# Altium schematic sheet klpfly.SchDoc: klpfly
size 599 x 400 mm; Organization: 国产飞控; Address1: AT32F435VMT7; Address2: 北京; Address3: 房山; Address4: 测试版本; DocumentNumber: 1; Revision: v1.0; SheetNumber: 1; SheetTotal: 1
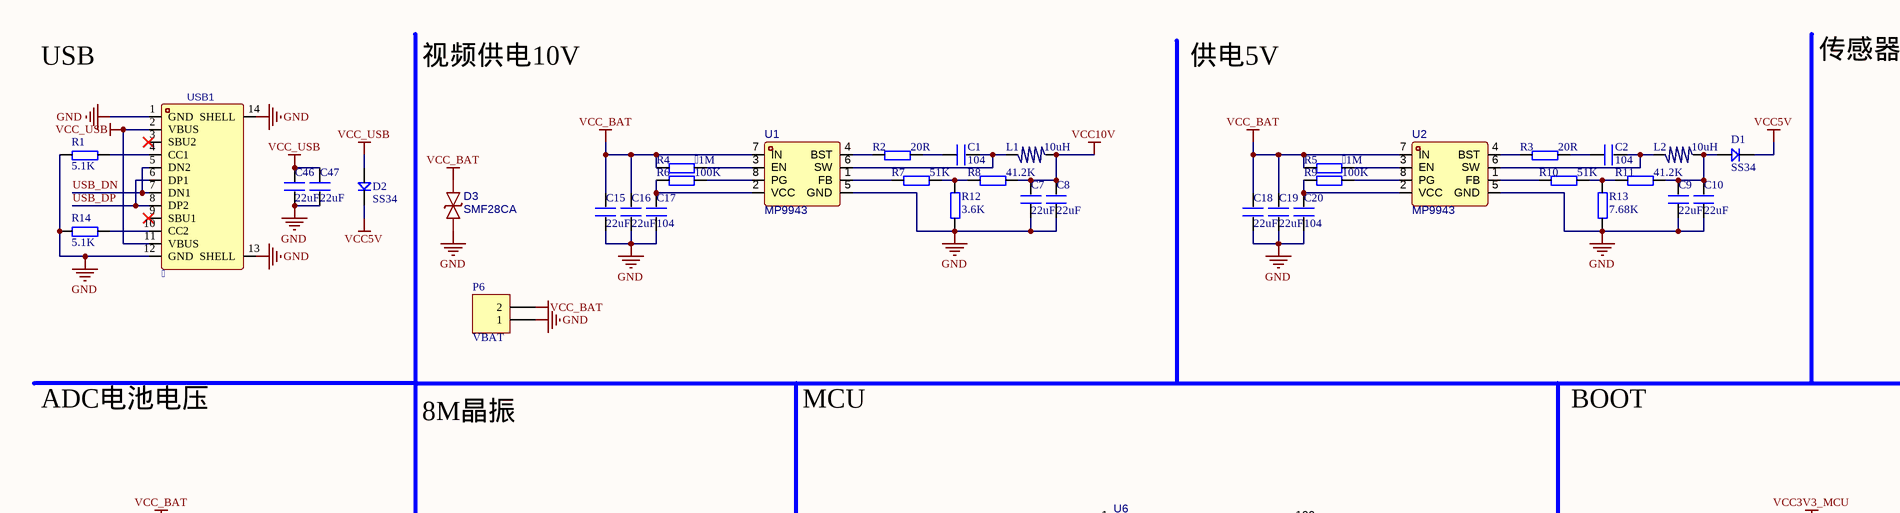
[diagram p0: klpfly.SchDoc, top left]
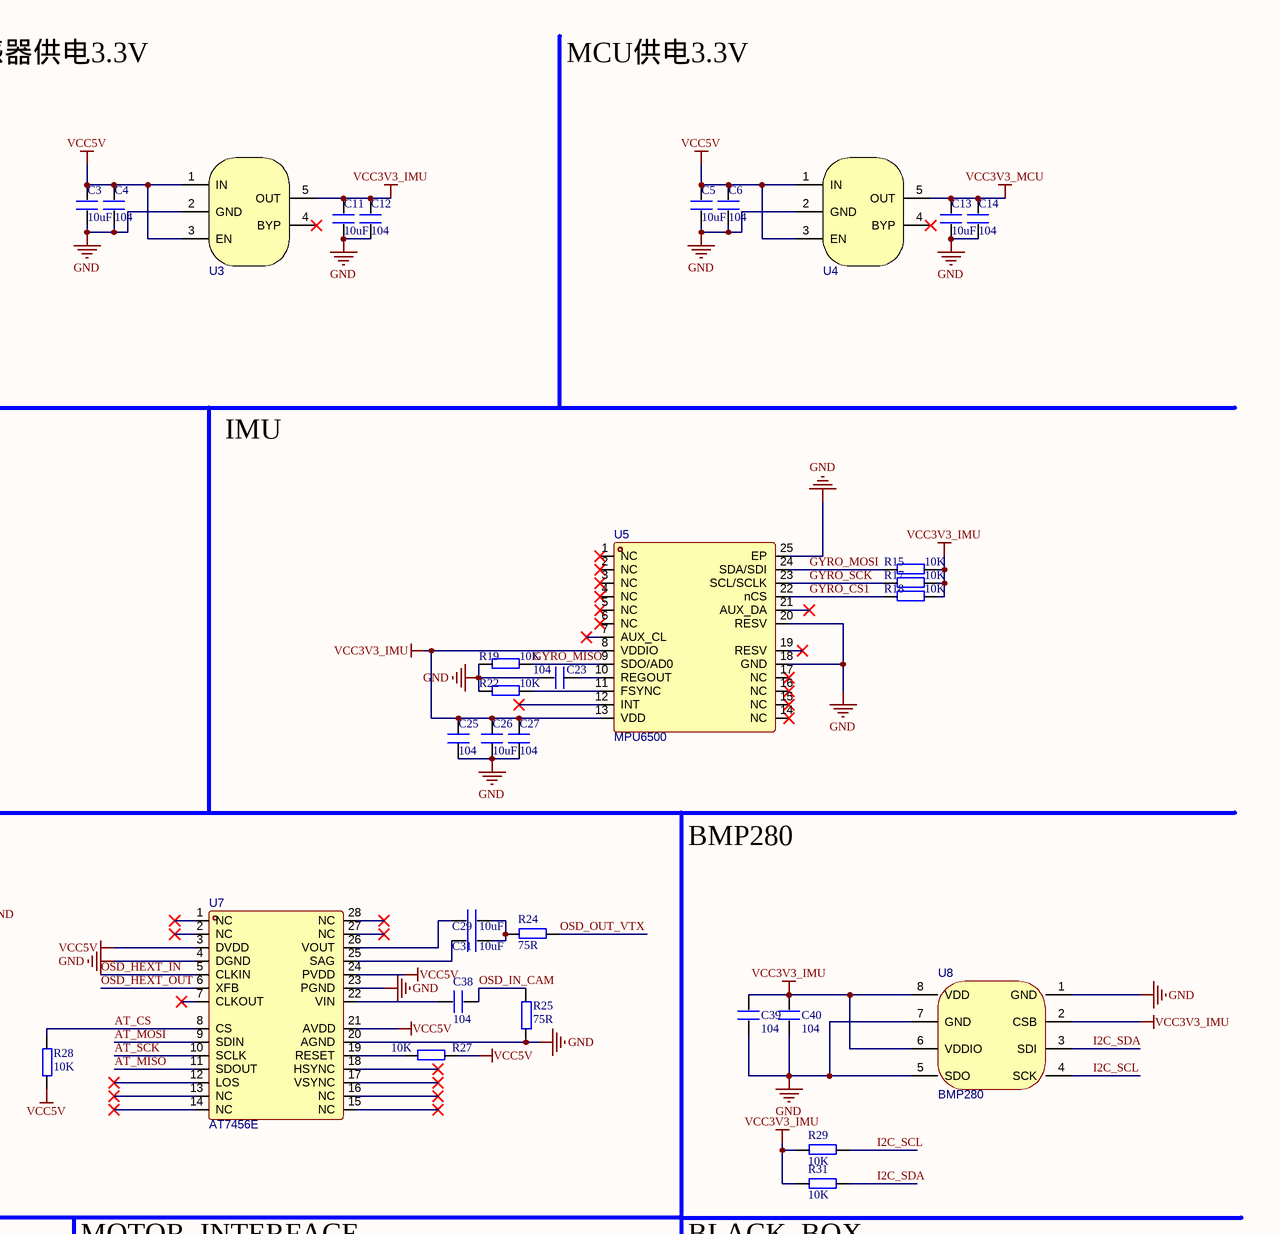
[diagram p1: klpfly.SchDoc, top right]
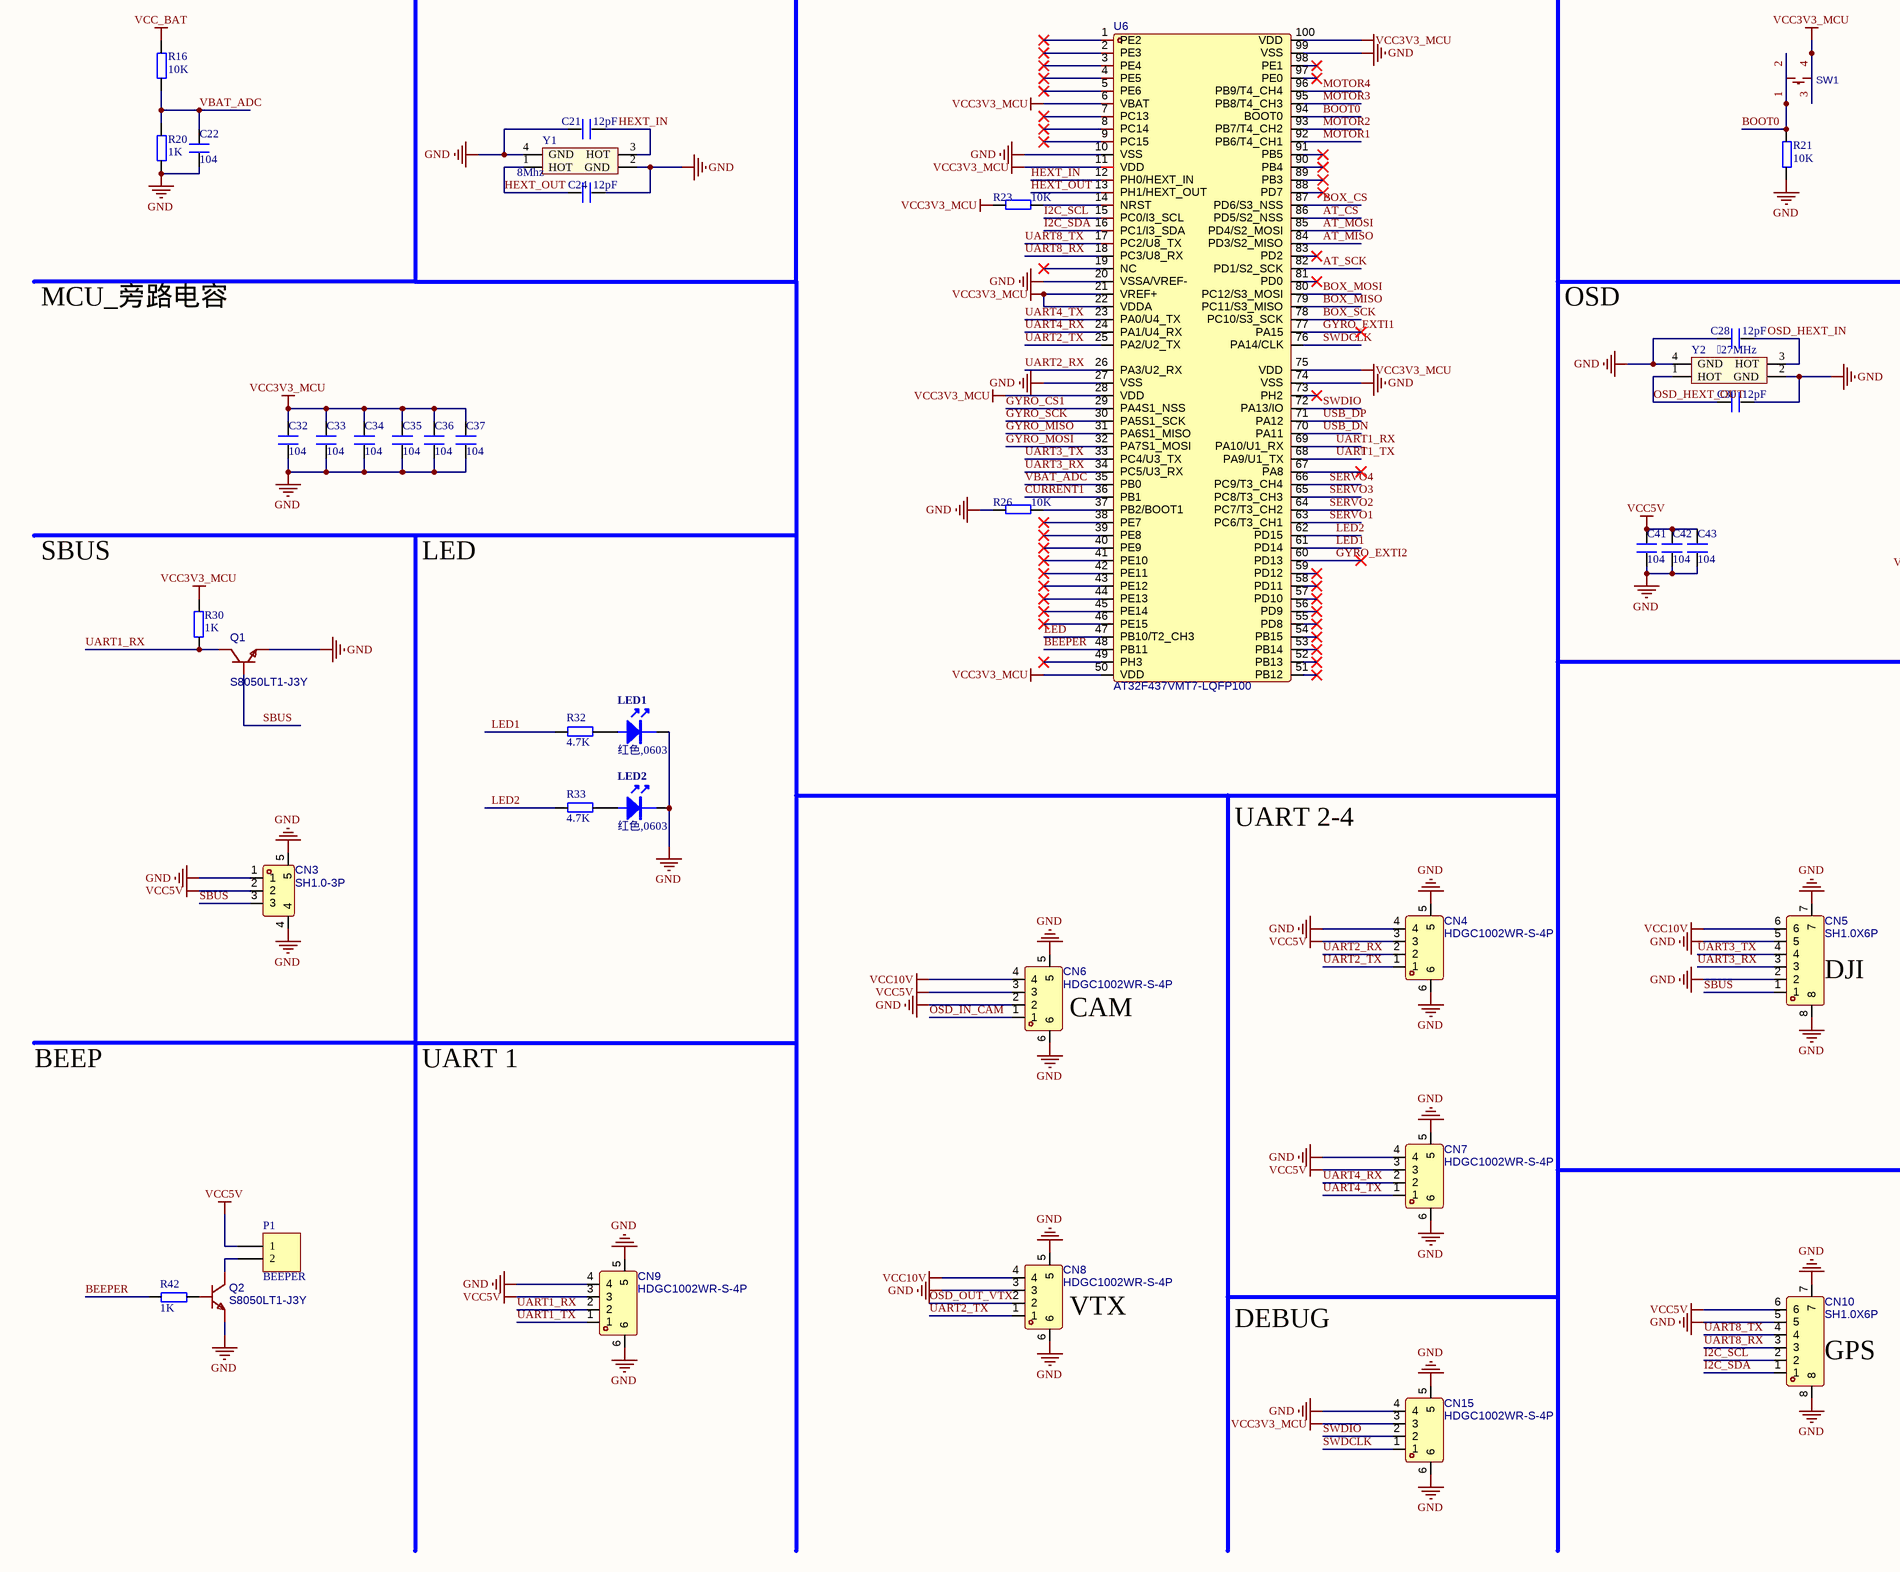
[diagram p2: klpfly.SchDoc, bottom left]
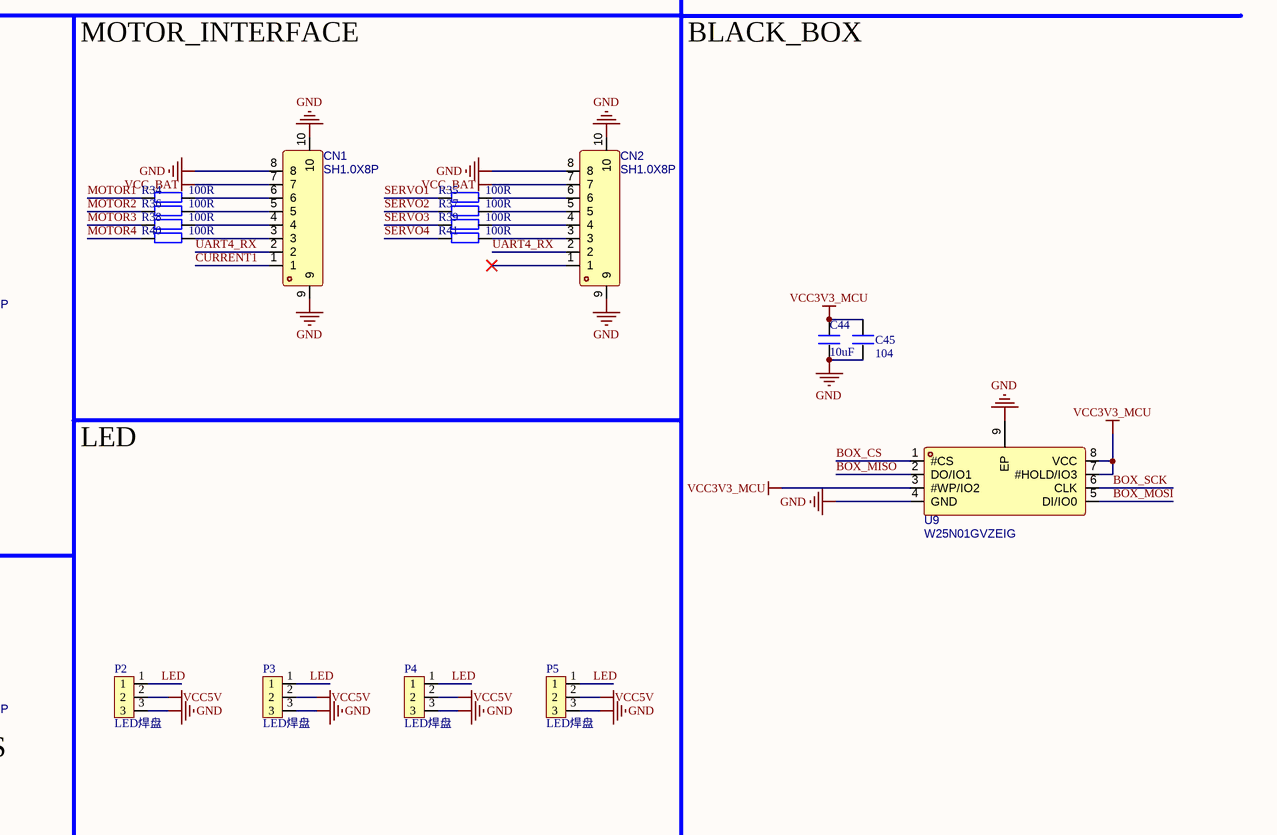
[diagram p3: klpfly.SchDoc, bottom right]

## Parts
C1  104  [0402C]
C2  104  [0402C]
C3  10uF  [0603C]
C4  104  [0402C]
C5  10uF  [0603C]
C6  104  [0402C]
C7  22uF  [0805C]
C8  22uF  [0805C]
C9  22uF  [0805C]
C10  22uF  [0805C]
C11  10uF  [0603C]
C12  104  [0402C]
C13  10uF  [0603C]
C14  104  [0402C]
C15  22uF  [0805C]
C16  22uF  [0805C]
C17  104  [0402C]
C18  22uF  [0805C]
C19  22uF  [0805C]
C20  104  [0402C]
C21  12pF  [0402C]
C22  104  [0402C]
C23  104  [0402C]
C24  12pF  [0402C]
C25  104  [0402C]
C26  10uF  [0603C]
C27  104  [0402C]
C28  12pF  [0402C]
C29  10uF  [0603C]
C30  12pF  [0402C]
C31  10uF  [0603C]
C32  104  [0402C]
C33  104  [0402C]
C34  104  [0402C]
C35  104  [0402C]
C36  104  [0402C]
C37  104  [0402C]
C38  104  [0402C]
C39  104  [0402C]
C40  104  [0402C]
C41  104  [0402C]
C42  104  [0402C]
C43  104  [0402C]
C44  10uF  [0603C]
C45  104  [0402C]
C46  22uF  [0805C]
C47  22uF  [0805C]
CN1  SH1.0X8P  [CONN-SMD_8P-P1.00_WAFER-SH1.0-8PWB]
CN2  SH1.0X8P  [CONN-SMD_8P-P1.00_WAFER-SH1.0-8PWB]
CN3  SH1.0-3P  [CONN-SMD_3P-P1.00_HDGC_HDGC1002WR-S-3P]
CN4  HDGC1002WR-S-4P  [CONN-SMD_4P-P1.00_HDGC_HDGC1002WR-S-4P]
CN5  SH1.0X6P  [CONN-SMD_6P-P1.00_MEGASTAR_ZX-SH1.0-6PWT]
CN6  HDGC1002WR-S-4P  [CONN-SMD_4P-P1.00_HDGC_HDGC1002WR-S-4P]
CN7  HDGC1002WR-S-4P  [CONN-SMD_4P-P1.00_HDGC_HDGC1002WR-S-4P]
CN8  HDGC1002WR-S-4P  [CONN-SMD_4P-P1.00_HDGC_HDGC1002WR-S-4P]
CN9  HDGC1002WR-S-4P  [CONN-SMD_4P-P1.00_HDGC_HDGC1002WR-S-4P]
CN10  SH1.0X6P  [CONN-SMD_6P-P1.00_MEGASTAR_ZX-SH1.0-6PWT]
CN15  HDGC1002WR-S-4P  [CONN-SMD_4P-P1.00_HDGC_HDGC1002WR-S-4P]
D1  SS34  [SOD-123]
D2  SS34  [SOD-123]
D3  SMF28CA  [SOD-123_L2.7-W1.8-LS3.7-BI]
L1  10uH  [IND-SMD_L4.3-W4.0_GPSR0420]
L2  10uH  [IND-SMD_L4.3-W4.0_GPSR0420]
LED1  value 红色,0603  [LED-0603]  (hidden comment: LED1)
LED2  value 红色,0603  [LED-0603]  (hidden comment: LED1)
P1  BEEPER  [2P]
P2  LED焊盘  [3P]
P3  LED焊盘  [3P]
P4  LED焊盘  [3P]
P5  LED焊盘  [3P]
P6  VBAT  [2P]
Q1  S8050LT1-J3Y  [SOT-23_L2.9-W1.3-P1.90-LS2.4-BR]
Q2  S8050LT1-J3Y  [SOT-23_L2.9-W1.3-P1.90-LS2.4-BR]
R1  5.1K  [0402R]
R2  20R  [0402R]
R3  20R  [0402R]
R4  1M  [0402R]
R5  1M  [0402R]
R6  100K  [0402R]
R7  51K  [0402R]
R8  41.2K  [0402R]
R9  100K  [0402R]
R10  51K  [0402R]
R11  41.2K  [0402R]
R12  3.6K  [0402R]
R13  7.68K  [0402R]
R14  5.1K  [0402R]
R15  10K  [0402R]
R16  10K  [0402R]
R17  10K  [0402R]
R18  10K  [0402R]
R19  10K  [0402R]
R20  1K  [0402R]
R21  10K  [0402R]
R22  10K  [0402R]
R23  10K  [0402R]
R24  75R  [0402R]
R25  75R  [0402R]
R26  10K  [0402R]
R27  10K  [0402R]
R28  10K  [0402R]
R29  10K  [0402R]
R30  1K  [0402R]
R31  10K  [0402R]
R32  4.7K  [0402R]
R33  4.7K  [0402R]
R34  100R  [0402R]
R35  100R  [0402R]
R36  100R  [0402R]
R37  100R  [0402R]
R38  100R  [0402R]
R39  100R  [0402R]
R40  100R  [0402R]
R41  100R  [0402R]
R42  1K  [0402R]
SW1  TS3425BA  [SW-SMD_4P-L4.2-W3.2-P2.15-LS4.6-1]  (value not drawn)
U1  MP9943  [QFN-8-3X3]
U2  MP9943  [QFN-8-3X3]
U3  SPX3819M5-L-3-3/TR  [SOT-23-5_L3.0-W1.7-P0.95-LS2.8-BL]  (value not drawn)
U4  SPX3819M5-L-3-3/TR  [SOT-23-5_L3.0-W1.7-P0.95-LS2.8-BL]  (value not drawn)
U5  MPU6500  [QFN-24_L3.0-W3.0-P0.40-BL-EP]
U6  AT32F437VMT7-LQFP100  [LQFP-100_L14.0-W14.0-P0.50-LS16.0-TL]
U7  AT7456E  [TSSOP-28_L9.7-W4.4-P0.65-LS6.4-BL-EP5.5]
U8  BMP280  [SENSOR-TH_BMP280-BL]
U9  W25N01GVZEIG  [WSON-8_L8.0-W6.10-P1.27-EP]
USB1    [USB-C-SMD_TYPE-C-6PIN-2MD-073]
Y1  8Mhz  [XTAL3225]
Y2  27MHz  [XTAL3225]

## Nets
GND: C3.1 C4.1 C5.1 C6.1 C7.1 C8.1 C9.1 C10.1 C11.1 C12.1 C13.1 C14.1 C15.1 C16.1 C17.1 C18.1 C19.1 C20.1 C21.1 C22.1 C23.2 C24.1 C25.1 C26.1 C27.1 C28.1 C30.1 C32.1 C33.1 C34.1 C35.1 C36.1 C37.1 C39.1 C40.1 C41.1 C42.1 C43.1 C44.1 C45.1 C46.1 C47.1 CN1.8 CN1.9 CN1.10 CN2.8 CN2.9 CN2.10 CN3.1 CN3.4 CN3.5 CN4.4 CN4.5 CN4.6 CN5.2 CN5.5 CN5.7 CN5.8 CN6.2 CN6.5 CN6.6 CN7.4 CN7.5 CN7.6 CN8.3 CN8.5 CN8.6 CN9.4 CN9.5 CN9.6 CN10.5 CN10.7 CN10.8 CN15.4 CN15.5 CN15.6 D3.1 LED1.2 LED2.2 P2.3 P3.3 P4.3 P5.3 P6.1 Q1.2 Q2.2 R1.1 R12.1 R13.1 R14.1 R19.2 R20.1 R21.1 R22.2 R25.1 R26.2 U1.5(GND) U2.5(GND) U3.2(GND) U4.2(GND) U5.18(GND) U5.20(RESV) U5.25(EP) U6.10(VSS) U6.20(VSSA/VREF-) U6.27(VSS) U6.74(VSS) U6.99(VSS) U7.4(DGND) U7.20(AGND) U7.23(PGND) U8.1(GND) U8.5(SDO) U8.7(GND) U9.4(GND) U9.9(EP) USB1.1(GND) USB1.12(GND) USB1.13(SHELL) USB1.14(SHELL) Y1.2(GND) Y1.4(GND) Y2.2(GND) Y2.4(GND)
VCC3V3_IMU: C11.2 C12.2 C25.2 C26.2 C27.2 C39.2 C40.2 R15.1 R17.1 R18.1 R29.2 R31.2 U3.5(OUT) U5.8(VDDIO) U5.13(VDD) U8.2(CSB) U8.6(VDDIO) U8.8(VDD)
VCC3V3_MCU: C13.2 C14.2 C32.2 C33.2 C34.2 C35.2 C36.2 C37.2 C44.2 C45.2 CN15.3 R23.2 R30.1 SW1.3 SW1.4 U4.5(OUT) U6.6(VBAT) U6.11(VDD) U6.21(VREF+) U6.22(VDDA) U6.28(VDD) U6.50(VDD) U6.75(VDD) U6.100(VDD) U9.3(#WP/IO2) U9.7(#HOLD/IO3) U9.8(VCC)
VCC5V: C3.2 C4.2 C5.2 C6.2 C41.2 C42.2 C43.2 CN3.2 CN4.3 CN6.3 CN7.3 CN9.3 CN10.6 D1.2 D2.2 P1.1 P2.2 P3.2 P4.2 P5.2 R27.1 R28.1 U3.1(IN) U3.3(EN) U4.1(IN) U4.3(EN) U7.3(DVDD) U7.21(AVDD) U7.24(PVDD)
VCC10V: C7.2 C8.2 CN5.6 CN6.4 CN8.4 L1.1 R8.2
VCC_BAT: C15.2 C16.2 C18.2 C19.2 CN1.7 CN2.7 D3.2 P6.2 R4.1 R5.1 R16.2 U1.7(IN) U2.7(IN)
VCC_USB: C46.2 C47.2 D2.1 USB1.2(VBUS) USB1.11(VBUS)
: CN9.1 U6.68(PA9/U1_TX)  [also labelled UART1_TX]
AT_CS: R28.2 U6.86(PD5/S2_NSS) U7.8(CS)
AT_MISO: U6.84(PD3/S2_MISO) U7.11(SDOUT)
AT_MOSI: U6.85(PD4/S2_MOSI) U7.9(SDIN)
AT_SCK: U6.82(PD1/S2_SCK) U7.10(SCLK)
BEEPER: R42.1 U6.48(PB11)
BOOT0: R21.2 SW1.1 SW1.2 U6.94(BOOT0)
BOX_CS: U6.87(PD6/S3_NSS) U9.1(#CS)
BOX_MISO: U6.79(PC11/S3_MISO) U9.2(DO/IO1)
BOX_MOSI: U6.80(PC12/S3_MOSI) U9.5(DI/IO0)
BOX_SCK: U6.78(PC10/S3_SCK) U9.6(CLK)
CURRENT1: CN1.1 U6.36(PB1)
GYRO_CS1: R18.2 U5.22(nCS) U6.29(PA4S1_NSS)
GYRO_EXTI1: U6.77(PA15)
GYRO_EXTI2: U6.60(PD13)
GYRO_MISO: R19.1 U5.9(SDO/AD0) U6.31(PA6S1_MISO)
GYRO_MOSI: R15.2 U5.24(SDA/SDI) U6.32(PA7S1_MOSI)
GYRO_SCK: R17.2 U5.23(SCL/SCLK) U6.30(PA5S1_SCK)
HEXT_IN: C21.2 U6.12(PH0/HEXT_IN) Y1.3(HOT)
HEXT_OUT: C24.2 U6.13(PH1/HEXT_OUT) Y1.1(HOT)
I2C_SCL: CN10.2 R29.1 U6.15(PC0/I3_SCL) U8.4(SCK)
I2C_SDA: CN10.1 R31.1 U6.16(PC1/I3_SDA) U8.3(SDI)
LED: P2.1 P3.1 P4.1 P5.1 U6.47(PB10/T2_CH3)
LED1: R32.2 U6.61(PD14)
LED2: R33.2 U6.62(PD15)
MOTOR1: R34.2 U6.92(PB6/T4_CH1)
MOTOR2: R36.2 U6.93(PB7/T4_CH2)
MOTOR3: R38.2 U6.95(PB8/T4_CH3)
MOTOR4: R40.2 U6.96(PB9/T4_CH4)
OSD_HEXT_IN: C28.2 U7.5(CLKIN) Y2.3(HOT)
OSD_HEXT_OUT: C30.2 U7.6(XFB) Y2.1(HOT)
OSD_IN_CAM: C38.1 CN6.1 R25.2
OSD_OUT_VTX: CN8.2 R24.1
SBUS: CN3.3 CN5.1 Q1.1
SERVO1: R35.2 U6.63(PC6/T3_CH1)
SERVO2: R37.2 U6.64(PC7/T3_CH2)
SERVO3: R39.2 U6.65(PC8/T3_CH3)
SERVO4: R41.2 U6.66(PC9/T3_CH4)
SWDCLK: CN15.1 U6.76(PA14/CLK)
SWDIO: CN15.2 U6.72(PA13/IO)
UART1_RX: CN9.2 Q1.3 R30.2 U6.69(PA10/U1_RX)
UART2_RX: CN4.2 U6.26(PA3/U2_RX)
UART2_TX: CN4.1 CN8.1 U6.25(PA2/U2_TX)
UART3_RX: CN5.3 U6.34(PC5/U3_RX)
UART3_TX: CN5.4 U6.33(PC4/U3_TX)
UART4_RX: CN1.2 CN2.2 CN7.2 U6.24(PA1/U4_RX)
UART4_TX: CN7.1 U6.23(PA0/U4_TX)
UART8_RX: CN10.3 U6.18(PC3/U8_RX)
UART8_TX: CN10.4 U6.17(PC2/U8_TX)
USB_DN: U6.70(PA11) USB1.5(DN2) USB1.7(DN1)
USB_DP: U6.71(PA12) USB1.6(DP1) USB1.8(DP2)
VBAT_ADC: C22.2 R16.1 R20.2 U6.35(PB0)
NetC1_1: C1.1 L1.2 U1.6(SW)
NetC1_2: C1.2 R2.2
NetC2_1: C2.1 L2.2 U2.6(SW)
NetC2_2: C2.2 R3.2
NetC9_2: C9.2 C10.2 D1.1 L2.1 R11.2
NetC17_2: C17.2 R6.1 U1.2(VCC)
NetC20_2: C20.2 R9.1 U2.2(VCC)
NetC23_1: C23.1 U5.10(REGOUT)
NetC29_1: C29.1 C31.1 R24.2
NetC29_2: C29.2 U7.26(VOUT)
NetC31_2: C31.2 U7.25(SAG)
NetC38_2: C38.2 U7.22(VIN)
NetCN1_3: CN1.3 R40.1
NetCN1_4: CN1.4 R38.1
NetCN1_5: CN1.5 R36.1
NetCN1_6: CN1.6 R34.1
NetCN2_3: CN2.3 R41.1
NetCN2_4: CN2.4 R39.1
NetCN2_5: CN2.5 R37.1
NetCN2_6: CN2.6 R35.1
NetLED1_1: LED1.1 R32.1
NetLED2_1: LED2.1 R33.1
NetP1_2: P1.2 Q2.3
NetQ2_1: Q2.1 R42.2
NetR1_2: R1.2 USB1.4(CC1)
NetR2_1: R2.1 U1.4(BST)
NetR3_1: R3.1 U2.4(BST)
NetR4_2: R4.2 U1.3(EN)
NetR5_2: R5.2 U2.3(EN)
NetR6_2: R6.2 U1.8(PG)
NetR7_1: R7.1 U1.1(FB)
NetR7_2: R7.2 R8.1 R12.2
NetR9_2: R9.2 U2.8(PG)
NetR10_1: R10.1 U2.1(FB)
NetR10_2: R10.2 R11.1 R13.2
NetR14_2: R14.2 USB1.10(CC2)
NetR22_1: R22.1 U5.11(FSYNC)
NetR23_1: R23.1 U6.14(NRST)
NetR26_1: R26.1 U6.37(PB2/BOOT1)
NetR27_2: R27.2 U7.19(RESET)

Not connected (* = marked no-connect by the designer): CN2 1*; U3 4(BYP)*; U4 4(BYP)*; U5 1(NC)* 2(NC)* 3(NC)* 4(NC)* 5(NC)* 6(NC)* 7(AUX_CL)* 12(INT)* 14(NC)* 15(NC)* 16(NC)* 17(NC)* 19(RESV)* 21(AUX_DA)*; U6 1(PE2)* 2(PE3)* 3(PE4)* 4(PE5)* 5(PE6)* 7(PC13)* 8(PC14)* 9(PC15)* 19(NC)* 38(PE7)* 39(PE8)* 40(PE9)* 41(PE10)* 42(PE11)* 43(PE12)* 44(PE13)* 45(PE14)* 46(PE15)* 49(PH3)* 51(PB12)* 52(PB13)* 53(PB14)* 54(PB15)* 55(PD8)* 56(PD9)* 57(PD10)* 58(PD11)* 59(PD12)* 67(PA8)* 73(PH2)* 81(PD0)* 83(PD2)* 88(PD7)* 89(PB3)* 90(PB4)* 91(PB5)* 97(PE0)* 98(PE1)*; U7 1(NC)* 2(NC)* 7(CLKOUT)* 12(LOS)* 13(NC)* 14(NC)* 15(NC)* 16(NC)* 17(VSYNC)* 18(HSYNC)* 27(NC)* 28(NC)*; USB1 3(SBU2)* 9(SBU1)*

## Notes on the sheet
- USB
- 视频供电10V
- 供电5V
- 传感器供电3.3V
- MCU供电3.3V
- ADC电池电压
- MCU
- BOOT
- 8M晶振
- IMU
- MCU_旁路电容
- OSD
- BMP280
- SBUS
- LED
- MOTOR_INTERFACE
- (near R31) BLACK_BOX
- UART 2-4
- (near CN5) DJI
- BEEP
- UART 1
- (near CN6) CAM
- (near CN8) VTX
- DEBUG
- (near CN10) GPS
- Title
- Size:
- Date:
- File:
- 400x600
- Number:
- Time:
- Revision:
- Sheet
- of

## Library data of the parts
C1-C47 = C
CN1 CN2 = WAFER_SMT_1.0X8: SH1.0 8P; Manufacturer: null; Convert to PCB: yes; UniqueId: ggebe725300a9fc9f2b; ModelTransform: 407.873,198.8185,0,0,0,0,-0.001,-16.732,0; Device: WAFER_SMT_1.0X8; Supplier: LCSC; Supplier Part: C9900021939; Manufacturer Part: WAFER_SMT_1.0X8; JLCPCB Part Class: Extended Part; Add into BOM: yes; SymbolName: SH1.0X8P; FootprintName: CONN-SMD_8P-P1.00_WAFER-SH1.0-8PWB; OriginModelName: CONN-SMD_8P-P1.00_WAFER-SH1.0-8PWB
CN3 = HDGC1002WR-S-3P: SH1.0 3P; Manufacturer: HDGC(华德共创); Convert to PCB: yes; UniqueId: gge2ce44b7eaad9832b; ModelTransform: 210.63,196.85,0,0,0,0,0,-9.565,0; Device: HDGC1002WR-S-3P; Supplier: LCSC; Supplier Part: C2936213; Manufacturer Part: HDGC1002WR-S-3P; JLCPCB Part Class: Extended Part; Add into BOM: yes; SymbolName: SH1.0-3P; FootprintName: CONN-SMD_3P-P1.00_HDGC_HDGC1002WR-S-3P; OriginModelName: CONN-SMD_3P-P1.00_HDGC_HDGC1002WR-S-3P
CN4 CN6-CN9 CN15 = HDGC1002WR-S-4P: SH1.0 4P; Manufacturer: HDGC(华德共创); Convert to PCB: yes; UniqueId: ggee5a51ee7bd50bb1d; ModelTransform: 249.9995,196.85,0,0,0,0,0,-5.906,0; Device: HDGC1002WR-S-4P; Supplier: LCSC; Supplier Part: C2936214; Manufacturer Part: HDGC1002WR-S-4P; JLCPCB Part Class: Extended Part; Add into BOM: yes; SymbolName: HDGC1002WR-S-4P; FootprintName: CONN-SMD_4P-P1.00_HDGC_HDGC1002WR-S-4P; OriginModelName: CONN-SMD_4P-P1.00_HDGC_HDGC1002WR-S-4P
CN5 CN10 = ZX-SH1.0-6PWT: SH1.0 6P; Manufacturer: Megastar(兆星); Convert to PCB: yes; UniqueId: ggecd9d3fcf4734ba22; ModelTransform: 329.1332,198.8185,0,0,0,0,0.002,-7.876,0; Device: ZX-SH1.0-6PWT; Supplier: LCSC; Supplier Part: C7430448; Manufacturer Part: ZX-SH1.0-6PWT; JLCPCB Part Class: Extended Part; link: https://so.szlcsc.com/global.html?k=C7430448&ref=editor; Add into BOM: yes; SymbolName: SH1.0X6P; FootprintName: CONN-SMD_6P-P1.00_MEGASTAR_ZX-SH1.0-6PWT; OriginModelName: CONN-SMD_6P-P1.00_MEGASTAR_ZX-SH1.0-6PWT
D1 D2 = D: 1N4148
D3 = SMF28CA: Manufacturer: AnBon(安邦); Convert to PCB: yes; UniqueId: gge8336ca0810bb463b; ModelTransform: 145.669,70.866,0,0,0,0,0,0,0; Device: SMF28CA; Supplier: LCSC; Supplier Part: C435496; Manufacturer Part: SMF28CA; JLCPCB Part Class: Extended Part; link: https://so.szlcsc.com/global.html?k=C435496&ref=editor; Add into BOM: yes; SymbolName: SMF28CA; FootprintName: SOD-123_L2.7-W1.8-LS3.7-BI; OriginModelName: SOD-123_L2.7-W1.8-LS3.7-BI
L1 L2 = L
LED1 LED2 = LED1: 红色,0603,0603,*,RoHS; 物料代码: 1.04.05.0008; 名称: 发光二极管; 封装: 0603; 设备封装名称: LED0603-RED; 贴片和直插: SMT; 器件优选方案: 优先选用; RoHS: RoHS; 型号: 红色,0603; ComponentLink1Description: ErpDataInfo; ComponentLink1URL: http://erp.zlgmcu.com/ErpExt/ErpData/ListMateriel.aspx?pkey=1.04.05.0008
P1 P6 = Header 2: Header, 2-Pin; LatestRevisionDate: 17-Jul-2002; LatestRevisionNote: Re-released for DXP Platform.; Publisher: Altium Limited
Q1 Q2 = S8050LT1-J3Y: Manufacturer: FH(风华); Convert to PCB: yes; UniqueId: gge1c8eb3e3ebf663b6; OriginModelName: SOT-23-3P_L2.9-W1.3-H1.0-LS2.4-P0.95; ModelTransform: 98.64468,114.173,0,180,0,0,0.001,0.001,0; Device: S8050LT1-J3Y; Supplier: LCSC; Supplier Part: C2962087; Manufacturer Part: S8050LT1-J3Y; link: https://atta.szlcsc.com/upload/public/pdf/source/20220411/740B3F4857AB400E9826209E74F1EDA4.pdf; Add into BOM: yes; SymbolName: S8050LT1-J3Y; FootprintName: SOT-23_L2.9-W1.3-P1.90-LS2.4-BR
R1-R42 = R
SW1 = TS3425BA: Manufacturer: SHOU HAN(首韩); Contributor: LCSC; Package Display: No; Supplier: LCSC; Supplier Part: C2681476; Manufacturer Part: TS3425BA; JLCPCB Part Class: Extended Part; spicePre: S; spiceSymbolName: TS3425BA
U1 U2 = MP9943: Convert to PCB: yes; UniqueId: ggeb87cc7bca5c8949e; Device: MP9943; Add into BOM: yes; SymbolName: MP9943; FootprintName: QFN-8-3X3
U3 U4 = SPX3819M5-L-3-3/TR: Manufacturer: MaxLinear(迈凌); Convert to PCB: yes; UniqueId: gge70c12bce5ebcd7d5; OriginModelName: SOT-23-5_L2.9-W1.6-H1.1-LS2.8-P0.95; ModelTransform: 114.173,109.636,0,180,0,0,0,-0.001,0; Device: SPX3819M5-L-3-3/TR; Supplier: LCSC; Manufacturer Part: SPX3819M5-L-3-3/TR; Supplier Part: C9055; JLCPCB Part Class: Extended Part; Add into BOM: yes; SymbolName: SPX3819M5-L-3-3/TR; FootprintName: SOT-23-5_L3.0-W1.7-P0.95-LS2.8-BL
U5 = MPU-6500: Manufacturer: TDK InvenSense(应美盛); Convert to PCB: yes; UniqueId: gge6fb0faa0bb8ee760; OriginModelName: QFN-24_L3.0-W3.0-H0.9-P0.40-BL-EP; ModelTransform: 118.11,118.11,0,90,0,0,0,0,0; Device: MPU-6500; Supplier: LCSC; Manufacturer Part: MPU-6500; Supplier Part: C50278; JLCPCB Part Class: Extended Part; Add into BOM: yes; SymbolName: MPU6500; FootprintName: QFN-24_L3.0-W3.0-P0.40-BL-EP
U6 = AT32F435VMT7: Manufacturer: ARTERY（雅特力）; Convert to PCB: yes; UniqueId: ggece277d5420079038; OriginModelName: LQFP-100_L14.0-W14.0-H1.4-LS16.0-P0.50; ModelTransform: 629.921,629.921,0,270,0,0,0,0,0; Device: AT32F435VMT7; Supplier: LCSC; Supplier Part: C3029578; Manufacturer Part: AT32F435VMT7; link: https://atta.szlcsc.com/upload/public/pdf/source/20220608/9A6D4578C11CEA8ECA586071DFEBC06A.pdf; Add into BOM: yes; SymbolName: AT32F437VMT7-LQFP100; FootprintName: LQFP-100_L14.0-W14.0-P0.50-LS16.0-TL
U7 = AT7456E: Manufacturer: ZHONGKEWEI; Convert to PCB: yes; UniqueId: gge0ef7d474198b7014; ModelTransform: 381.889,251.968,0,0,0,0,0,0.005,0; Device: AT7456E; Supplier: LCSC; Manufacturer Part: AT7456E; Supplier Part: C82351; JLCPCB Part Class: Extended Part; Add into BOM: yes; SymbolName: AT7456E; FootprintName: TSSOP-28_L9.7-W4.4-P0.65-LS6.4-BL-EP5.5; OriginModelName: TSSOP-28_L9.7-W4.4-P0.65-LS6.4-BL-EP5.5
U8 = BMP280: Manufacturer: Bosch; Convert to PCB: yes; UniqueId: gge447de30e0e3d1cf2; OriginModelName: LGA-8_L2.0-W2.5-H1.0-P0.65; ModelTransform: 98.425,78.74,0,270,0,0,0.005,-0.001,0; Device: BMP280; Supplier: LCSC; Manufacturer Part: BMP280; Supplier Part: C83291; JLCPCB Part Class: Extended Part; Add into BOM: yes; SymbolName: BMP280; FootprintName: SENSOR-TH_BMP280-BL
U9 = W25N01GVZEIG: Manufacturer: Winbond Elec; Convert to PCB: yes; UniqueId: ggee63176ef5aab684c; OriginModelName: WSON-8_L8.0-W6.0-H0.8-P1.27; ModelTransform: 315.7474,236.22,0,0,0,0,0,0,0; Device: W25N01GVZEIG; Supplier: LCSC; Supplier Part: C88868; Manufacturer Part: W25N01GVZEIG; JLCPCB Part Class: Extended Part; Add into BOM: yes; SymbolName: W25N01GVZEIG; FootprintName: WSON-8_L8.0-W6.10-P1.27-EP
USB1 = TYPE-C 16PIN 2MD(073): Manufacturer: SHOU HAN(首韩); Contributor: LCSC; Package Display: Yes; Supplier: LCSC; Supplier Part: C2765186; Manufacturer Part: TYPE-C 16PIN 2MD(073); JLCPCB Part Class: Extended Part; spicePre: U; spiceSymbolName: TYPE-C 16PIN 2MD(073)
Y1 Y2 = XTAL_3225: 3225贴片无源晶振